# EAGLE board BMS (EAGLE 6.6.0)
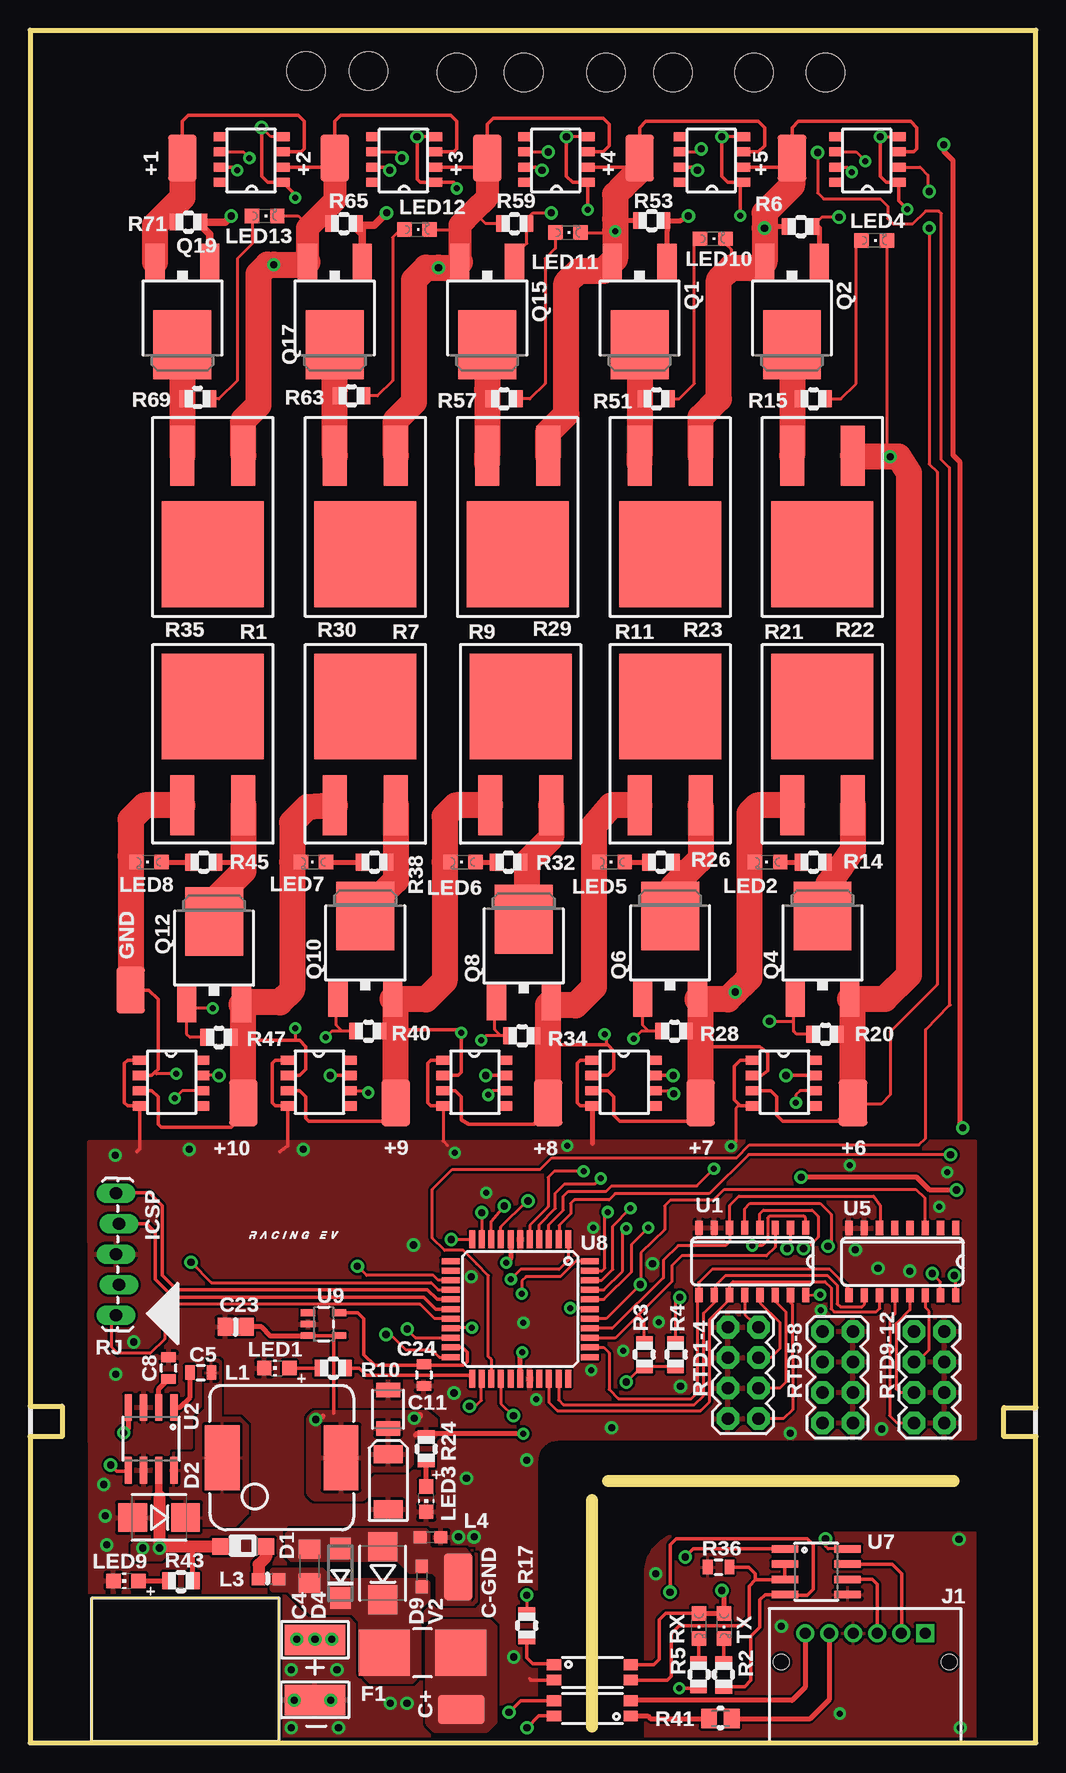
[diagram p1: board, top side]
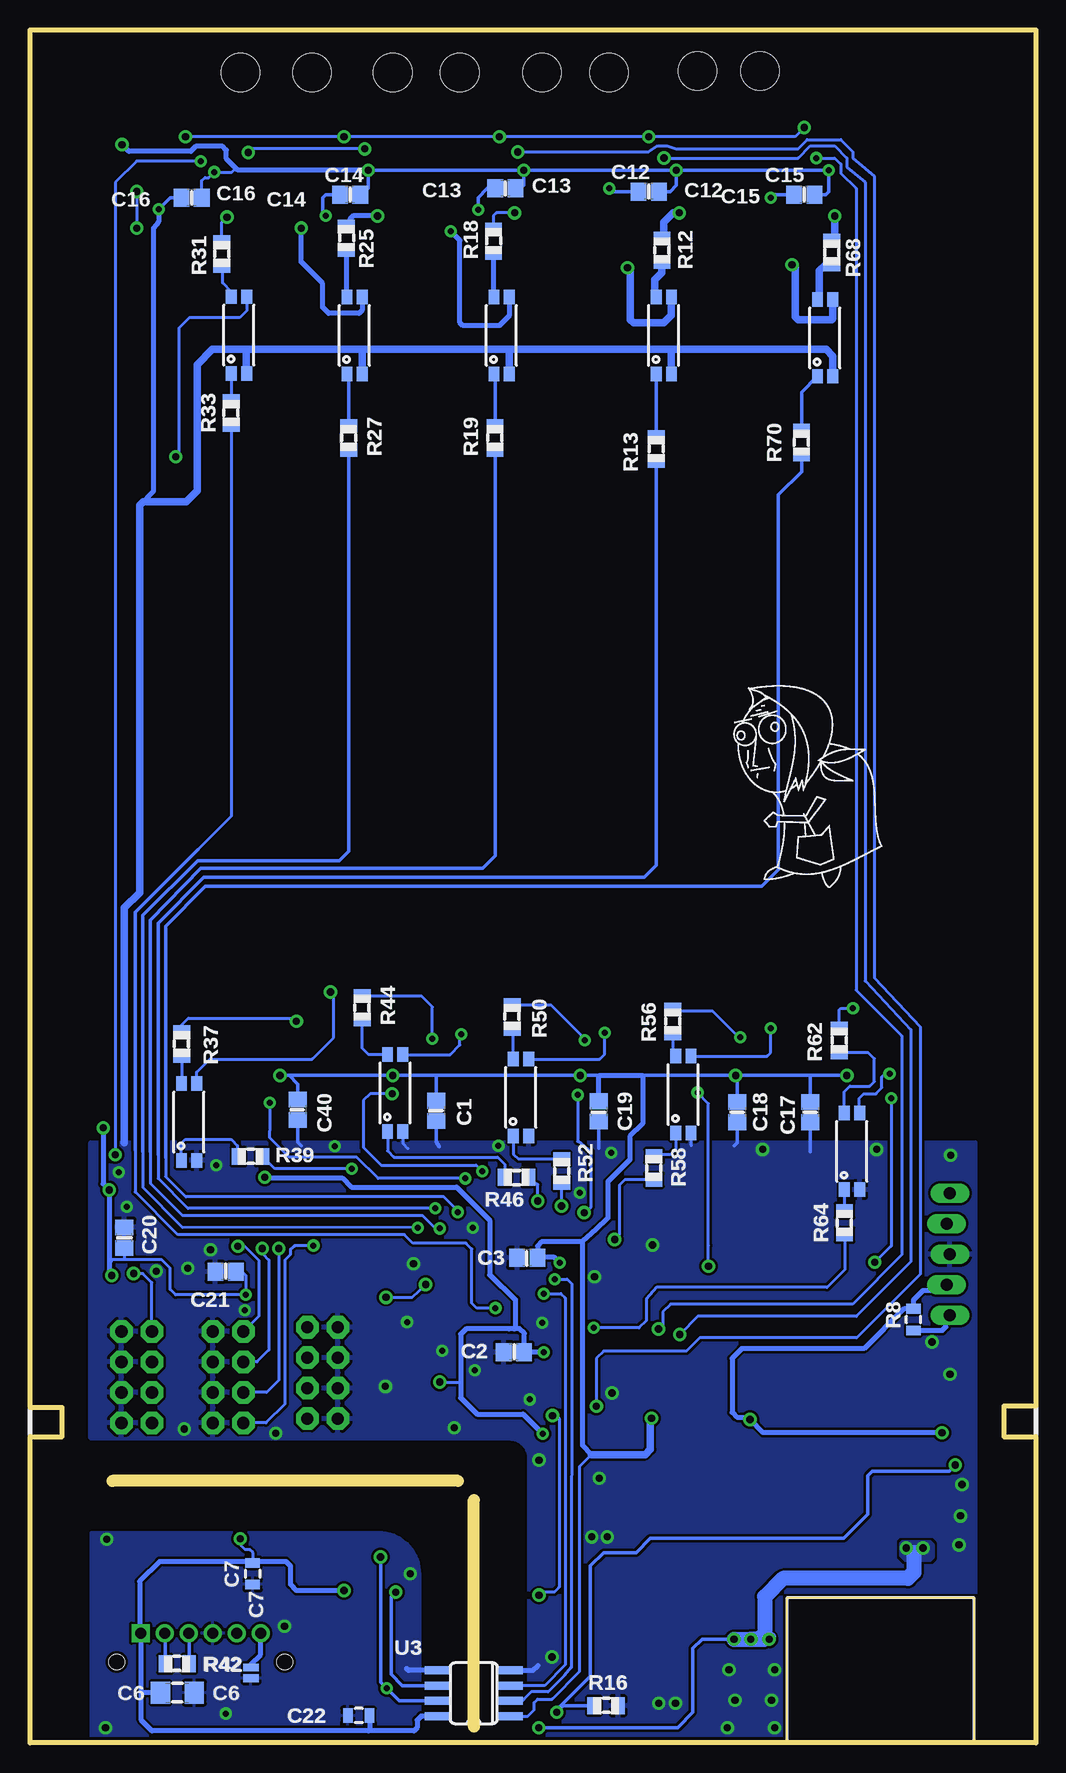
[diagram p2: board, bottom side, seen from below]

Size 83.82 x 142.75 mm. Coordinates in mm from the lower left corner, seen from the top.
Outline: 46.84,1.38 46.84,20.27
Outline: 48.15,21.84 76.96,21.84
Outline: 0,0 83.82,0 83.82,25.53 81.15,25.53 81.15,27.94 83.82,27.94 83.82,142.75 0,142.75 0,28.07 2.67,28.07 2.67,25.53 0,25.53 0,0
Copper layers (1*16): Top 0.035mm / dielectric 1.5mm / Bottom 0.035mm
Design rules "SparkFun *": minimum track width 8mil, minimum drill 18mil, track to track 8mil, track to pad 8mil, pad to pad 8mil, via to via 8mil, smd to smd 8mil, copper to edge 10mil, drill to drill 8mil, minimum pad ring 12mil, minimum via ring 10mil, stop-mask expansion 4mil, vias tented up to drill 25mil, thermal gap 10mil
Holes 3.2 mm at 22.99,139.32 28.19,139.32 35.56,139.19 41.15,139.19 48.01,139.19 53.59,139.19 60.32,139.19 66.29,139.19

## Footprints (pad centres in the part's own frame; a part is rotated, then mirrored left to right if it is on the bottom)
LUXEON-PAD = smd 3.9 x 2.4: P$1 0,0
C0805 = smd 1.3 x 1.5: 1 -0.85,0; 2 0.85,0
1206 = smd 1.6 x 1.8: 1 -1.4,0; 2 1.4,0
0805 = smd 0.8 x 1.2: 1 -0.9,0; 2 0.9,0
EIA6032 = smd 1.5 x 2.4: P$1 -2.3,0; P$2 2.3,0
UVR1J101MPD-CUTOUT = smd 5.08 x 2.54: + 0,2.5; - 0,-2.5
1210 = smd 1.2 x 2: 1 -1.6,0; 2 1.6,0
SOD123 = smd 1.4 x 1.4: A 1.9,0; C -1.9,0
SMB-DIODE = smd 2.4 x 2.4: A 2.2,0; C -2.2,0
DO-214AC = smd 1.8 x 1.7: A 2.05,0; C -2.05,0
0154XXDR = smd 4.24 x 3.81: 1 -3.19,0; 2 3.19,0
1X05_LOCK_LONGPADS = drill 1.016 long: 1 0,0; 2 2.54,-0.254; 3 5.08,0; 4 7.62,-0.254; 5 10.16,0
559350610 = drill 0.9 square: 1 -5,0 | drill 0.9: 2 -3,0; 3 -1,0; 4 1,0; 5 3,0; 6 5,0 | hole 1.3: 7,2.4; -7,2.4
INDUCTOR_5X3 = smd 2.9 x 5.4: 1 -4.95,0; 2 4.95,0
0603 = smd 1.1 x 1: 1 -0.85,0; 2 0.85,0
CHIP-LED0805 = smd 1.2 x 1.2: A 0,-1.05; C 0,1.05
CHIPLED_0805 = smd 1.2 x 1.2: A 0,-1.05; C 0,1.05
DPAK = smd 1.6 x 3: 1 -2.28,-4.04; 3 2.28,-4.04 | smd 4.826 x 5.715: 2 0,2.858
PFC10-5RF1 = smd 2 x 5: 1 -2.54,-8.22; 2 2.54,-8.22 | smd 8.5 x 8.8: TP 0,0
R0805 = smd 1.1 x 1.4: 1 -1,0; 2 1,0
M0805 = smd 1.3 x 1.6: 1 -0.95,0; 2 0.95,0
2X4 = drill 1.016 pad 1.88 octagon: 1 -3.81,-1.27; 2 -3.81,1.27; 3 -1.27,-1.27; 4 -1.27,1.27; 5 1.27,-1.27; 6 1.27,1.27; 7 3.81,-1.27; 8 3.81,1.27
PAD-JUMPER-2-NO_NO_SILK = smd 0.635 x 1.27: 1 -0.45,0; 2 0.45,0
SO-16 = smd 0.6 x 1.2: 1 -4.445,-2.8; 2 -3.175,-2.8; 3 -1.905,-2.8; 4 -0.635,-2.8; 5 0.635,-2.8; 6 1.905,-2.8; 7 3.175,-2.8; 8 4.445,-2.8; 9 4.445,2.8; 10 3.175,2.8; 11 1.905,2.8; 12 0.635,2.8; 13 -0.635,2.8; 14 -1.905,2.8; 15 -3.175,2.8; 16 -4.445,2.8
SO-8 = smd 0.61 x 2.21: 1 -1.905,-2.616; 2 -0.635,-2.616; 3 0.635,-2.616; 4 1.905,-2.616; 5 1.905,2.616; 6 0.635,2.616; 7 -0.635,2.616; 8 -1.905,2.616
SOIC-8 = smd 0.66 x 2.032: 1 -1.905,-3.073; 2 -0.635,-3.073; 3 0.635,-3.073; 4 1.905,-3.073; 5 1.905,3.073; 6 0.635,3.073; 7 -0.635,3.073; 8 -1.905,3.073
TQFP-44 = smd 1.5 x 0.5: 1 -5.8,4; 2 -5.8,3.2; 3 -5.8,2.4; 4 -5.8,1.6; 5 -5.8,0.8; 6 -5.8,0; 7 -5.8,-0.8; 8 -5.8,-1.6; 9 -5.8,-2.4; 10 -5.8,-3.2; 11 -5.8,-4; 23 5.8,-4; 24 5.8,-3.2; 25 5.8,-2.4; 26 5.8,-1.6; 27 5.8,-0.8; 28 5.8,0; 29 5.8,0.8; 30 5.8,1.6; 31 5.8,2.4; 32 5.8,3.2; 33 5.8,4 | smd 0.5 x 1.5: 12 -4,-5.8; 13 -3.2,-5.8; 14 -2.4,-5.8; 15 -1.6,-5.8; 16 -0.8,-5.8; 17 0,-5.8; 18 0.8,-5.8; 19 1.6,-5.8; 20 2.4,-5.8; 21 3.2,-5.8; 22 4,-5.8; 34 4,5.8; 35 3.2,5.8; 36 2.4,5.8; 37 1.6,5.8; 38 0.8,5.8; 39 0,5.8; 40 -0.8,5.8; 41 -1.6,5.8; 42 -2.4,5.8; 43 -3.2,5.8; 44 -4,5.8
SOT23-5 = smd 0.55 x 1.2: 1 -0.95,-1.3; 2 0,-1.3; 3 0.95,-1.3; 4 0.95,1.3; 5 -0.95,1.3
LT1990 = smd 0.762 x 1.143: 1 0,0; 2 1.27,0; 3 2.54,0; 4 3.81,0; 5 3.81,5.207; 6 2.54,5.207; 7 1.27,5.207; 8 0,5.207
SSOP-4 = smd 1.2 x 0.9: 1 -3.2,0.67; 2 -3.2,-0.6; 3 3.2,-0.6; 4 3.2,0.67

## Placement (x,y rotation side)
+1  M01SMD  [LUXEON-PAD]  12.7,132.08 90 top
+2  M01SMD  [LUXEON-PAD]  25.4,132.08 90 top
+3  M01SMD  [LUXEON-PAD]  38.1,132.08 90 top
+4  M01SMD  [LUXEON-PAD]  50.8,132.08 90 top
+5  M01SMD  [LUXEON-PAD]  63.5,132.08 90 top
+6  M01SMD  [LUXEON-PAD]  68.58,53.34 90 top
+7  M01SMD  [LUXEON-PAD]  55.88,53.34 90 top
+8  M01SMD  [LUXEON-PAD]  43.18,53.34 90 top
+9  M01SMD  [LUXEON-PAD]  30.48,53.34 90 top
+10  M01SMD  [LUXEON-PAD]  17.78,53.34 90 top
C1  .1uF  [C0805]  49.97,52.67 270 bottom
C2  .1uF  [C0805]  43.49,32.57 180 bottom
C3  .1uF  [C0805]  42.38,40.43 180 bottom
C4  1uF  [1206]  23.3,14.74 90 top
C5  0.1uF  [0805]  14.22,30.86 0 top
C6  10uF  [1206]  71.54,4.19 0 bottom
C7  .1uF  [0805]  65.27,14.11 270 bottom
C8  0.1uF  [0805]  11.56,31.24 90 top
C9  68uF  [EIA6032]  29.86,21.77 270 top
C10  100uF  [UVR1J101MPD-CUTOUT]  23.75,6.1 0 top
C11  1uF  [1210]  29.84,27.81 90 top
C12  .1uF  [C0805]  32.26,129.29 180 bottom
C13  .1uF  [C0805]  44.2,129.54 180 bottom
C14  .1uF  [C0805]  57.15,129.03 180 bottom
C15  .1uF  [C0805]  19.3,129.03 180 bottom
C16  .1uF  [C0805]  70.36,128.78 180 bottom
C17  .1uF  [C0805]  18.8,52.58 270 bottom
C18  .1uF  [C0805]  24.89,52.58 270 bottom
C19  .1uF  [C0805]  36.42,52.63 270 bottom
C20  .1uF  [C0805]  75.95,42.11 90 bottom
C21  .1uF  [C0805]  67.51,39.27 180 bottom
C22  .1uF  [0805]  56.42,2.29 180 bottom
C23  .1uF  [C0805]  17.13,34.67 180 top
C24  0.1uF  [0805]  32.82,30.66 270 top
C40  .1uF  [C0805]  61.51,52.76 270 bottom
C+  M01SMD  [LUXEON-PAD]  35.94,2.79 180 top
C-GND  M01SMD  [LUXEON-PAD]  35.69,13.84 270 top
D1  1N4001  [SOD123]  17.77,16.37 0 top
D2  VS-30BQ060TRPBF  [SMB-DIODE]  10.75,18.78 180 top
D4  TVS  [DO-214AC]  25.88,14.14 90 top
D9  45V  [SMB-DIODE]  29.4,14.14 90 top
F1  01541.25DR  [0154XXDR]  32.71,7.52 180 top
GND  M01SMD  [LUXEON-PAD]  8.38,62.74 270 top
ICSP  [1X05_LOCK_LONGPADS]  7.17,35.64 90 top
J1  55935-0610  [559350610]  69.6,9.14 180 top
L1  7447714101  [INDUCTOR_5X3]  20.97,23.78 0 top
L3  FERITEBEAD  [0603]  19.89,13.66 180 top
L4  FERITEBEAD  [0603]  33.37,17.16 0 top
LED1  [CHIP-LED0805]  20.57,31.24 90 top
LED2  [CHIPLED_0805]  61.47,73.41 90 top
LED3  [CHIP-LED0805]  33.02,20.32 180 top
LED4  [CHIPLED_0805]  70.36,125.22 270 top
LED5  [CHIPLED_0805]  48.51,73.41 90 top
LED6  [CHIPLED_0805]  36.07,73.41 90 top
LED7  [CHIPLED_0805]  23.62,73.41 90 top
LED8  [CHIPLED_0805]  9.91,73.41 90 top
LED9  [CHIP-LED0805]  8.01,13.51 90 top
LED10  [CHIPLED_0805]  56.9,125.35 270 top
LED11  [CHIPLED_0805]  44.83,125.86 270 top
LED12  [CHIPLED_0805]  32.26,126.11 270 top
LED13  [CHIPLED_0805]  19.56,127.25 270 top
Q1  MJD127T4  [DPAK]  50.8,119.38 180 top
Q2  MJD127T4  [DPAK]  63.5,119.38 180 top
Q4  MJD127T4  [DPAK]  66.04,66.04 0 top
Q6  MJD127T4  [DPAK]  53.34,66.04 0 top
Q8  MJD127T4  [DPAK]  41.15,65.79 0 top
Q10  MJD127T4  [DPAK]  27.94,66.04 0 top
Q12  MJD127T4  [DPAK]  15.34,65.6 0 top
Q15  MJD127T4  [DPAK]  38.1,119.38 180 top
Q17  MJD127T4  [DPAK]  25.4,119.38 180 top
Q19  MJD127T4  [DPAK]  12.7,119.38 180 top
R1  PFC10-5RF1  [PFC10-5RF1]  15.24,86.36 0 top
R2  1k  [R0805]  57.81,5.66 270 top
R3  10k  [R0805]  51.21,32.36 90 top
R4  10k  [R0805]  53.8,32.36 90 top
R5  1k  [R0805]  55.71,5.69 270 top
R6  10k  [R0805]  64.21,126.37 0 top
R7  PFC10-5RF1  [PFC10-5RF1]  27.94,86.36 0 top
R8  10k  [0805]  10.19,35.28 90 bottom
R9  PFC10-5RF1  [PFC10-5RF1]  40.89,86.36 0 top
R10  1k  [R0805]  25.27,31.24 0 top
R11  PFC10-5RF1  [PFC10-5RF1]  53.34,86.36 0 top
R12  330  [R0805]  31.16,124.39 270 bottom
R13  200  [R0805]  31.62,107.82 90 bottom
R14  399  [R0805]  65.28,73.41 0 top
R15  399  [R0805]  65.28,112.01 180 top
R16  100k  [R0805]  35.81,3.11 180 bottom
R17  1k  [R0805]  41.4,9.78 90 top
R18  330  [R0805]  45.2,125.15 270 bottom
R19  200  [R0805]  45.06,108.75 90 bottom
R20  10k  [R0805]  66.25,59.07 180 top
R21  PFC10-5RF1  [PFC10-5RF1]  66.04,86.36 0 top
R22  PFC10-5RF1  [PFC10-5RF1]  66.04,99.06 180 top
R23  PFC10-5RF1  [PFC10-5RF1]  53.34,99.06 180 top
R24  1k  [R0805]  33.02,24.51 90 top
R25  330  [R0805]  57.46,125.4 270 bottom
R26  399  [R0805]  52.58,73.41 0 top
R27  200  [R0805]  57.27,108.75 90 bottom
R28  10k  [R0805]  53.67,59.33 180 top
R29  PFC10-5RF1  [PFC10-5RF1]  40.64,99.06 180 top
R30  PFC10-5RF1  [PFC10-5RF1]  27.94,99.06 180 top
R31  330  [R0805]  67.85,124.08 270 bottom
R32  399  [R0805]  39.88,73.41 0 top
R33  200  [R0805]  67.06,110.83 90 bottom
R34  10k  [R0805]  40.97,58.94 180 top
R35  PFC10-5RF1  [PFC10-5RF1]  15.24,99.06 180 top
R36  10k  [0805]  57.38,14.65 0 top
R37  330  [R0805]  71.18,58.24 270 bottom
R38  399  [R0805]  28.7,73.41 0 top
R39  200  [R0805]  65.44,48.88 180 bottom
R40  10k  [R0805]  28.15,59.33 180 top
R41  [M0805]  57.53,2.03 0 top
R42  120  [R0805]  71.56,6.59 180 bottom
R43  3.3k  [R0805]  12.58,13.51 0 top
R44  330  [R0805]  56.14,61.27 270 bottom
R45  399  [R0805]  14.48,73.41 0 top
R46  200  [R0805]  43.27,47.14 180 bottom
R47  10k  [R0805]  15.75,58.8 180 top
R50  330  [R0805]  43.64,60.5 270 bottom
R51  399  [R0805]  52.2,112.01 180 top
R52  200  [R0805]  39.51,47.66 90 bottom
R53  10k  [R0805]  51.82,126.87 0 top
R56  330  [R0805]  30.25,60.12 270 bottom
R57  399  [R0805]  39.5,112.01 180 top
R58  200  [R0805]  31.83,47.92 90 bottom
R59  10k  [R0805]  40.39,126.62 0 top
R62  330  [R0805]  16.38,58.55 270 bottom
R63  399  [R0805]  26.8,112.27 180 top
R64  200  [R0805]  15.94,43.35 90 bottom
R65  10k  [R0805]  26.16,126.62 0 top
R68  330  [R0805]  17.02,124.21 270 bottom
R69  399  [R0805]  13.97,112.01 180 top
R70  200  [R0805]  19.53,108.37 90 bottom
R71  10k  [R0805]  13.21,126.75 0 top
RTD1-4  M04X2  [2X4]  59.44,30.84 90 top
RTD5-8  M04X2  [2X4]  67.31,30.48 90 top
RTD9-12  M04X2  [2X4]  74.93,30.48 270 top
RX  [CHIPLED_0805]  55.74,9.75 180 top
SJ1  JUMPER-PAD-2-NO  [PAD-JUMPER-2-NO_NO_SILK]  65.4,5.84 270 bottom
TX  [CHIPLED_0805]  57.84,9.75 180 top
U1  SN74LV4051ADR  [SO-16]  60.2,40.13 180 top
U2  MAX5035  [SO-8]  10.09,25.34 180 top
U3  ISO7221ADR  [SOIC-8]  46.84,4.15 90 bottom
U5  SN74LV4051ADR  [SO-16]  72.69,40.11 180 top
U7  SN75HVD08DR  [SO-8]  65.51,14.27 270 top
U8  PIC18F45K22  [TQFP-44]  40.84,36.16 270 top
U9  LM4128CMF-2.0/NOPB  [SOT23-5]  24.47,34.9 270 top
U$1  LT1990  [LT1990]  60.2,56.9 270 top
U$2  LT1990  [LT1990]  46.86,56.9 270 top
U$3  LT1990  [LT1990]  34.42,56.9 270 top
U$4  LT1990  [LT1990]  21.46,56.9 270 top
U$5  LT1990  [LT1990]  9.14,56.9 270 top
U$6  LT1990  [LT1990]  59.44,130.05 90 top
U$7  LT1990  [LT1990]  46.48,130.05 90 top
U$8  LT1990  [LT1990]  33.78,130.05 90 top
U$9  LT1990  [LT1990]  21.08,130.05 90 top
U$10  TCMT1103-OPTO  [SSOP-4]  17.53,117.09 90 bottom
U$11  TCMT1103-OPTO  [SSOP-4]  30.97,117.29 90 bottom
U$12  TCMT1103-OPTO  [SSOP-4]  44.49,117.29 90 bottom
U$13  TCMT1103-OPTO  [SSOP-4]  56.74,117.29 90 bottom
U$14  TCMT1103-OPTO  [SSOP-4]  66.37,117.32 90 bottom
U$15  TCMT1103-OPTO  [SSOP-4]  70.53,51.75 90 bottom
U$16  TCMT1103-OPTO  [SSOP-4]  53.35,54.17 90 bottom
U$17  TCMT1103-OPTO  [SSOP-4]  42.87,53.79 90 bottom
U$18  TCMT1103-OPTO  [SSOP-4]  29.34,54.03 90 bottom
U$19  TCMT1103-OPTO  [SSOP-4]  15.29,49.31 90 bottom
U$20  INDPK1  [PICKIT-PIN-1]  9.76,35.78 270 top
U$21  OLD_LADYM  [0L-M]  25.32,71.26 0 bottom
U$22  LOGO  [L-MS]  15.24,41.2 0 top
U$23  TCMT1103-OPTO  [SSOP-4]  46.86,2.92 180 top
U$24  TCMT1103-OPTO  [SSOP-4]  46.86,5.84 0 top
U$55  LT1990  [LT1990]  72.39,130.05 90 top
V2  45Vdc  [0603]  32.64,13.86 270 top

## Tracks (layer width: path | path; a pad name or v marks a point on that pad's centre or on a via)
+5V  (via drill 0.5, 0.6)
  Top 0.254: v15.75,55.63 U$5.7 | U$1.7 65.43,55.63 | U1.16 65.76,37.31 v65.84,37.34 | U5.16 77.14,38.79 v77.01,38.96 | U$55.7 68.07,131.32 v68.48,130.91 | R4.1 R3.1 50.97,31.36 v49.68,30.07 | R24.2 33.02,25.63 32.87,25.78
  Top 0.305: U$9.7 17.02,131.32 v17.27,131.06 | U$6.7 55.37,131.32 v55.63,131.06 | U$7.7 42.16,131.32 42.42,131.06 v42.67,131.06 | U$8.7 29.72,131.32 v29.97,131.06 | U$2.7 v53.59,55.63 51.82,55.63 | v62.99,55.63 U$1.7 | U$3.7 v37.97,55.63 | U$4.7 v25.02,55.63 | 23.14,33.91 U9.3 U9.4 25.41,33.95 25.32,33.86 25.32,27.46
  Top 0.406: U8.28 40.84,32.39 v41.02,32.56 | U8.7 40.04,40.37 v39.67,40 | v77.22,46.08 74.98,46.08 73.91,47.14 v64.26,47.14 | v76.15,133.2 76.15,132.64 76.91,131.88 76.91,107.34 77.47,106.78 77.47,51.51 v77.72,51.26 | v23.82,26.96 24.12,26.96 24.42,27.26 | U2.4 8.19,26.23 v7.82,25.86 | v41.1,25.78 32.87,25.78 32.22,25.78 32.12,25.67 | 23.14,33.91 20.06,33.91 19.3,34.67 C23.1
  Top 0.61: v32.02,27.06 32.22,27.06 32.42,27.26
  Bottom 0.254: 75.95,40.28 72.85,40.28 72.14,39.57 72.14,37.8 71.68,37.34 v65.84,37.34 65.84,38.96 66.14,39.27 C21.1 | 75.95,40.28 77.01,40.28 77.11,40.03 v77.01,38.96 | 66.67,131.24 67,130.91 v68.48,130.91 68.94,130.45 69.24,130.45 69.51,130.19 C16.1 | C20.1 75.95,40.28 | 42.64,32.77 42.64,32.76 C2.1 42.42,32.34 | U3.1 42.34,2.24 41.82,2.76 41.82,3.36 41.52,3.66 40.32,3.66 38.02,5.96 38.02,23.04 37.03,24.03 | v49.68,30.07 47.98,30.07 47.93,30.02 | 43.38,36.74 43.37,36.95
  Bottom 0.305: v29.97,131.06 v17.27,131.06 17.27,129.29 17.53,129.03 C15.1 | v29.97,131.06 v42.67,131.06 | v42.67,131.06 v55.63,131.06 55.63,129.54 56.13,129.03 C14.1 | 62.23,55.63 v53.59,55.63 50.04,55.63 | 50.04,55.63 v37.97,55.63 36.45,55.63 | v25.02,55.63 32.77,55.63 | 36.37,55.63 36.45,55.63 | v15.75,55.63 18.8,55.63 | 18.8,55.63 v25.02,55.63 | C12.1 30.48,129.29 29.97,129.79 v29.97,131.06 | C13.1 42.93,129.54 42.67,129.79 v42.67,131.06 | C40.1 61.49,54.88 62.23,55.63 | 62.23,55.63 v62.99,55.63 | C1.1 49.97,55.55 50.04,55.63 | C19.1 36.45,55.63 | C18.1 24.89,55.5 v25.02,55.63 | C17.1 18.8,55.63 | 40.04,40.37 v39.67,40
  Bottom 0.406: v41.02,32.56 C2.1 42.64,32.77 42.63,34.14 43.04,34.52 43.54,34.52 43.37,34.52 | v39.67,40 40.13,40.46 41.5,40.46 C3.1 | C3.1 | C19.1 36.42,55.58 36.37,55.63 32.77,55.63 32.77,51.61 33.83,50.55 33.83,48.62 35.66,46.79 35.66,43.74 36.68,42.77 37.39,42.16 37.79,41.76 | 37.79,41.76 37.79,24.79 37.03,24.03 | v77.01,38.96 77.22,39.22 v77.22,46.08 77.72,46.58 v77.72,51.26 | v64.26,47.14 64.11,47.09 57.81,47.09 57.05,46.33 48.26,46.33 45.51,43.58 45.51,39 43.37,36.95 43.37,34.52 | v55.63,131.06 66.5,131.06 66.67,131.24 67.46,132.03 67.46,132.74 67.77,133.04 70,133.04 70.41,132.64 75.59,132.64 v76.15,133.2 | ICSP.2 7.89,37.72 9.4,37.72 10.19,36.92 R8.2 11,36.19 14.32,32.86 24.52,32.86 25.32,32.06 25.32,27.56 24.92,27.16 24.02,27.16 v23.82,26.96 22.72,25.86 v7.82,25.86 | 37.79,41.76 37.79,41.78 | 41.55,40.45 C3.1 | 43.37,34.52 43.89,34.52 47.47,34.52 47.93,34.06 47.93,30.02 47.93,28.76 46.57,27.4 42.73,27.4 v41.1,25.78 | 37.79,41.76 41.2,41.76 41.53,41.43 C3.1 | C3.1
  Bottom 0.61: 37.03,24.03 32.55,24.03 32.12,24.46 32.12,26.96 v32.02,27.06
  pour Top: 23.24,20.83 23.24,27.05 23.75,27.56 33.02,27.56 33.78,26.92 33.78,25.65 33.27,25.15 32.13,25.15 31.75,24.64 31.75,23.24 31.24,22.73 28.45,22.73 28.07,22.35 28.07,20.7 27.69,20.32 23.75,20.32
A
  Top 0.254: U8.31 43.24,28.38 43.94,27.69 55.88,27.69 56.64,28.45 56.64,35.31 58.17,36.83 58.17,37.2 U1.11 58.29,38.18 58.57,38.46 66.24,38.46 66.75,37.95 66.75,36.17 67,35.92 70.51,35.92 70.81,36.22 70.81,37.28 U5.11
B
  Top 0.254: 43.94,30.23 44.04,30.33 U8.32 44.04,28.6 44.45,28.19 55.37,28.19 56.13,28.96 56.13,35.81 57.15,36.83 57.15,37.2 | 57.15,37.2 U1.10 | 69.54,37.33 U5.10 69.54,37.28 69.54,36.58 69.34,36.37 67.51,36.37 67.26,36.58 67.26,38.15 66.45,38.96 57.96,38.96 57.15,38.15 57.15,37.2
B1  (via drill 0.5)
  Top 0.254: 46.65,39.37 U8.43 47.69,39.36 47.9,39.57 47.9,43.99 v48.16,44.25
  Bottom 0.254: 72.52,48.77 72.52,47.19 70.84,45.52 49.33,45.52 48.16,44.35 v48.16,44.25
  Bottom 0.305: R70.1 19.53,105.95 21.46,104.01 21.46,72.77 22.86,71.37 69.21,71.37 72.52,68.07 72.52,48.77
B2  (via drill 0.5)
  Top 0.254: U8.42 47.65,38.56 48.56,39.47 48.56,43.08 v50.04,44.55
  Bottom 0.254: 73.15,49.02 73.15,47.04 70.66,44.55 v50.04,44.55
  Bottom 0.305: R13.1 31.62,73.15 32.64,72.14 69.34,72.14 73.15,68.33 73.15,49.02
B3  (via drill 0.5)
  Top 0.254: U8.41 47.82,37.76 49.38,39.32 49.38,42.57 v49.68,42.88
  Bottom 0.254: 73.79,49.28 73.79,46.63 71.09,43.94 51.1,43.94 50.04,42.88 v49.68,42.88
  Bottom 0.305: R19.1 45.06,73.93 46.1,72.9 69.6,72.9 73.79,68.58 73.79,49.28
B4  (via drill 0.5)
  Top 0.254: U8.40 47.83,36.96 50.14,39.27 50.14,41.55 v51.51,42.93
  Bottom 0.254: 74.42,49.28 74.42,46.33 71.12,42.98 v51.51,42.93
  Bottom 0.305: R27.1 57.27,74.3 58.04,73.53 69.85,73.53 74.42,68.96 74.42,49.28
B5  (via drill 0.5)
  Top 0.254: U8.39 46.73,36.25 v45.03,36.25
  Bottom 0.254: 75.06,49.4 75.06,45.92 71.5,42.37 52.63,42.37 51.92,41.66 47.5,41.66 46.99,41.15 46.99,36.63 46.58,36.23 v45.03,36.25 | R33.1 67.06,77.21 69.85,74.42
  Bottom 0.305: 69.85,74.42 75.06,69.22 75.06,49.4
B6  (via drill 0.5)
  Top 0.254: U8.3 43.24,43.19 44.45,44.4 44.45,45.57 44.86,45.97 48.01,45.97 48.46,46.43 55.57,46.43 v57,47.85
  Bottom 0.254: v57,47.85 63.42,47.85 R39.1
B7  (via drill 0.6)
  Top 0.254: U8.8 39.24,43 41.4,45.16 v41.5,45.16
  Bottom 0.254: v41.5,45.16 41.5,46.52 R46.1
B8  (via drill 0.6)
  Top 0.254: U8.9 38.44,43.47 v39.52,44.75
  Bottom 0.254: v39.52,44.75 39.52,45.51 R52.1
B9  (via drill 0.6)
  Top 0.254: v35.1,41.96 U8.11
  Bottom 0.254: R58.1 34.26,46.92 34.7,46.48 34.7,42.37 v35.1,41.96
B10  (via drill 0.5)
  Top 0.254: v36.83,34.59 35.08,34.59 U8.19
  Bottom 0.254: R64.1 15.94,39.43 17.4,37.97 31.6,37.97 32.46,36.96 32.46,35.2 33.07,34.59 v36.83,34.59
C
  Top 0.254: U8.35 47.81,32.96 48.26,32.51 48.26,29.46 49.02,28.7 55.12,28.7 55.63,29.21 55.63,37.2 U1.9 55.73,37.36 55.73,38.35 56.84,39.47 66.65,39.47 68.25,37.87 U5.9
C1  (via drill 0.5, 0.6)
  Top 0.254: U$9.6 17.78,132.59 v18.29,132.08 | v31.44,34.49 32.11,33.78 35.02,33.78 U8.20
  Bottom 0.254: v18.29,132.08 16.76,132.08 16.26,131.57 16.26,130.81 14.99,129.54 14.99,62.74 11.18,58.93 11.18,40.66 15.26,36.58 30.43,36.58 31.09,35.92 31.09,34.8 v31.44,34.49
C2  (via drill 0.6)
  Top 0.254: U$8.6 30.48,132.59 v30.99,132.08 | 35.01,32.13 U8.22 34.12,32.16 33.52,32.76 31.32,32.76 30.04,34.04 v29.67,34.04